# EasyEDA Pro project FPGA-G1.eprj, schematic Schematic1, sheets 7 to 10 of 10

## Sheets
7 GD32F303CBT6
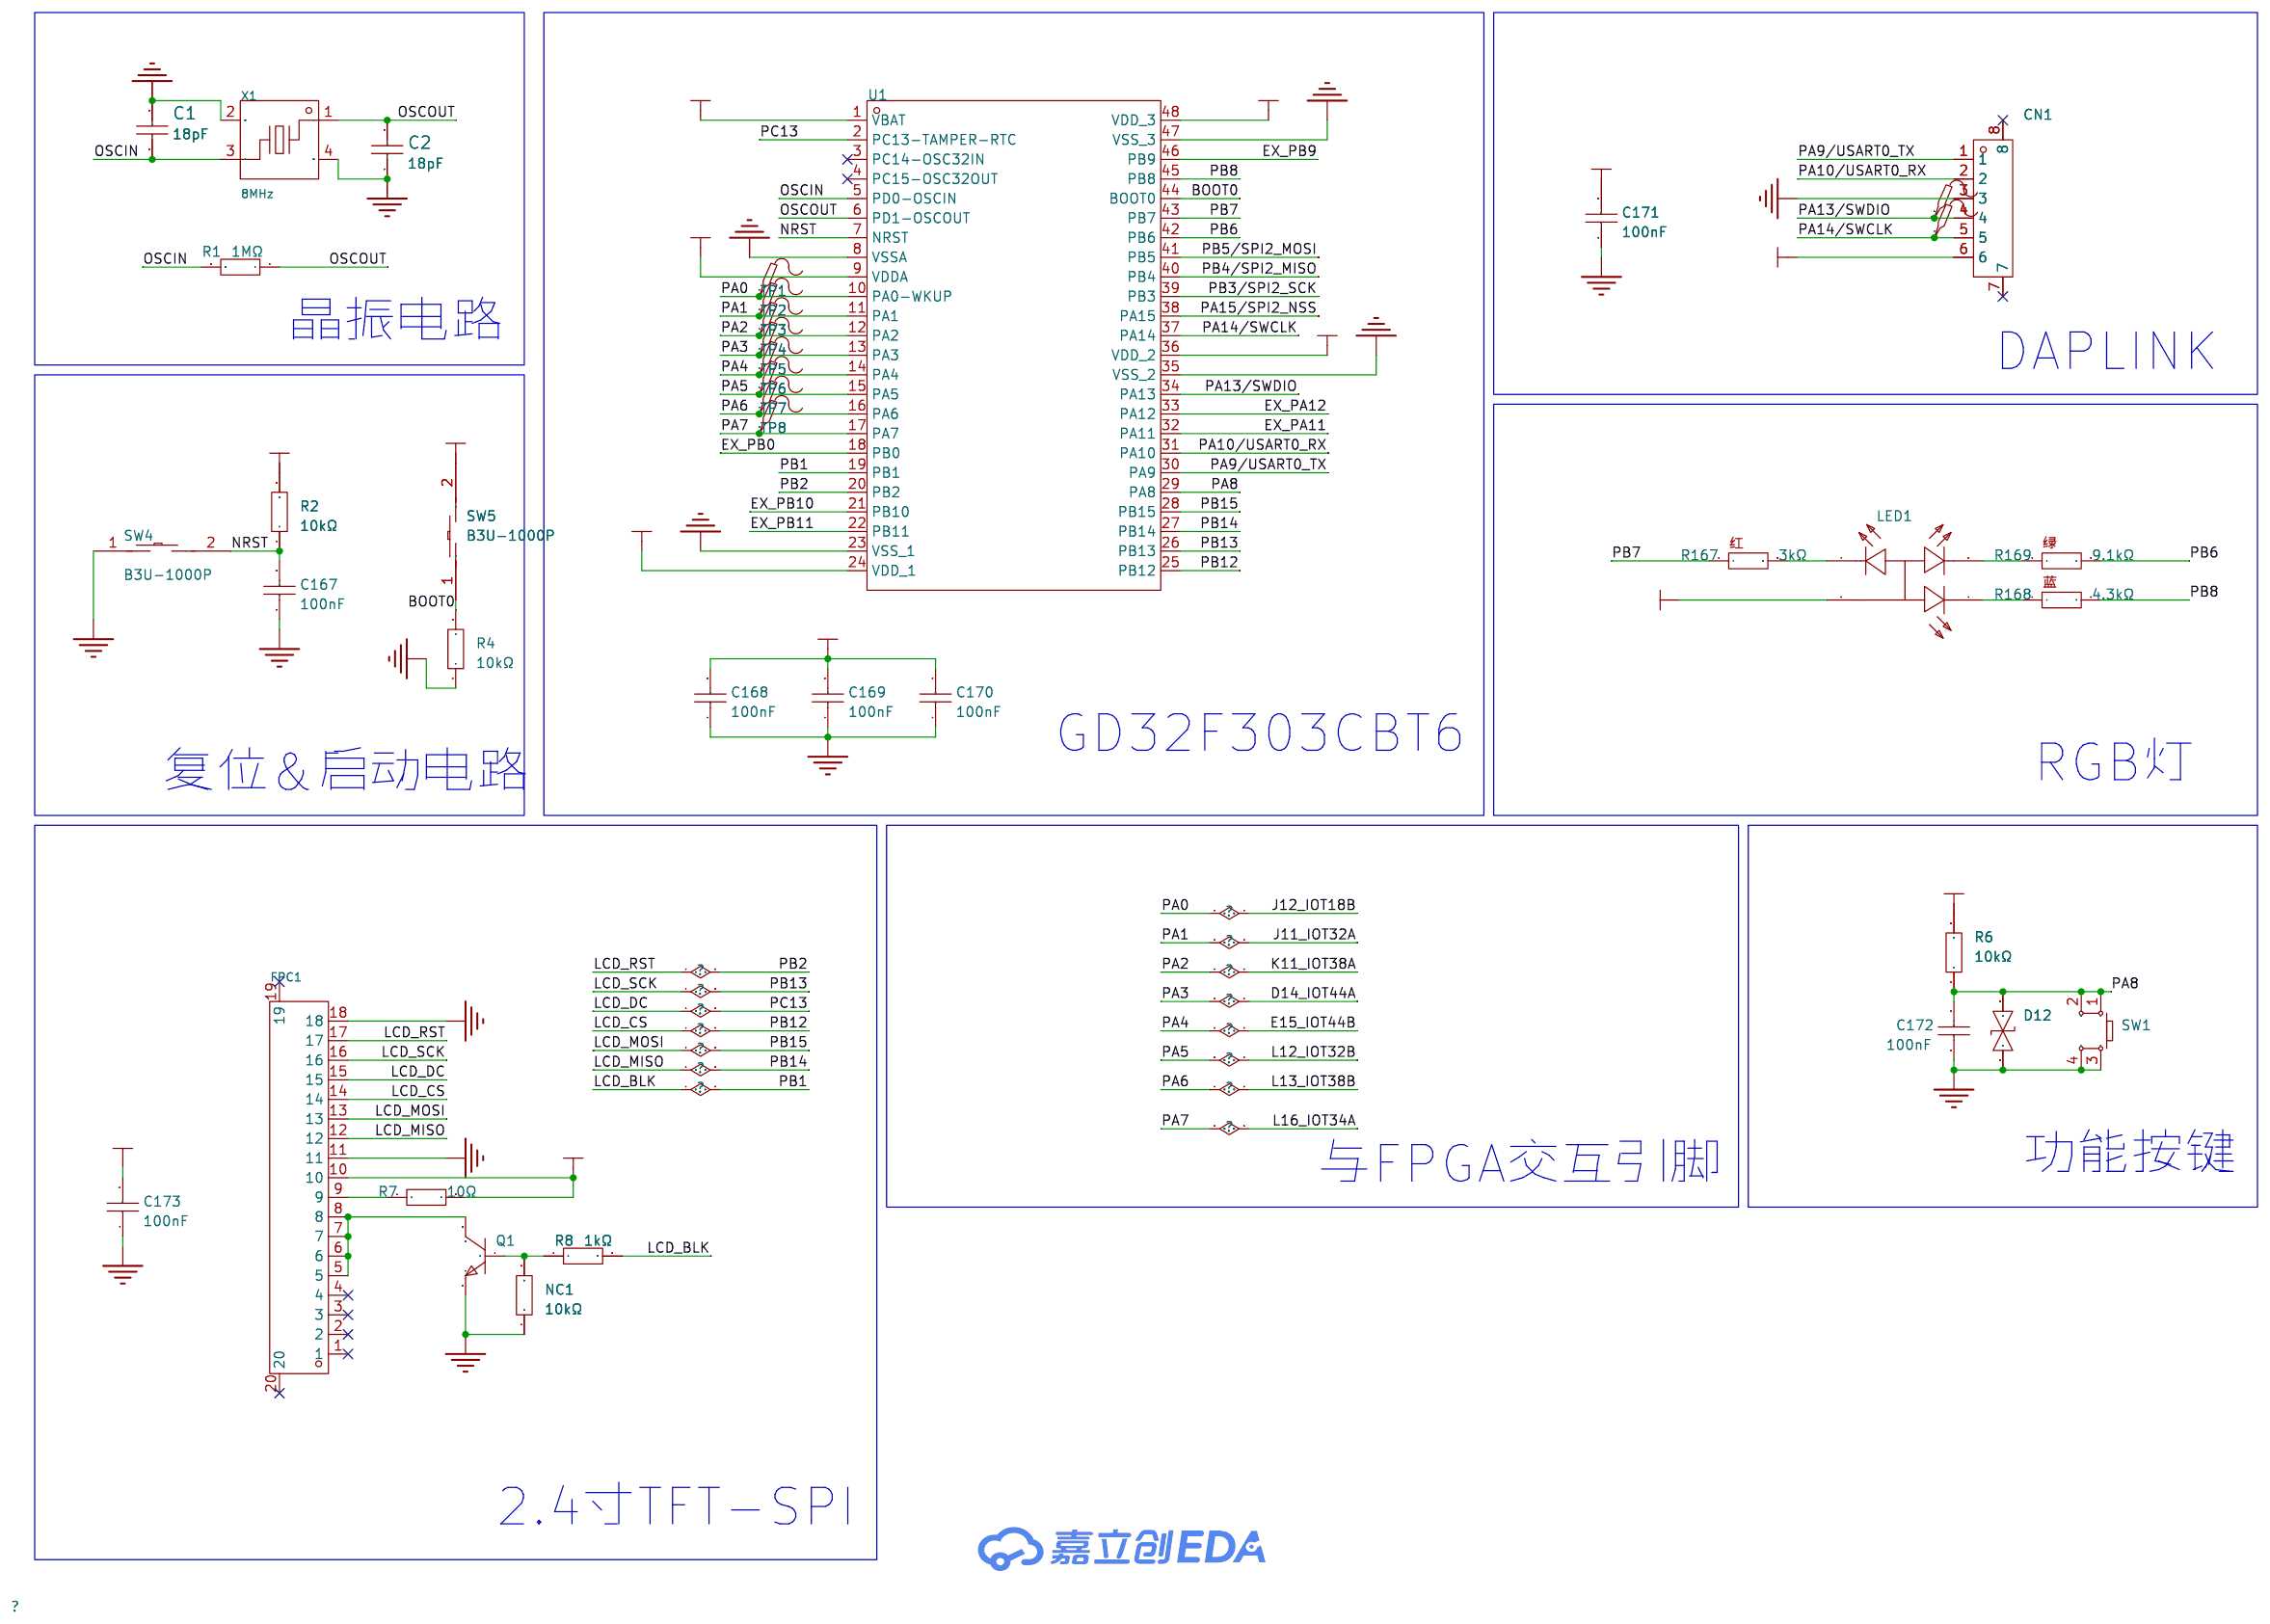
[diagram p6: GD32F303CBT6]
8 Expand
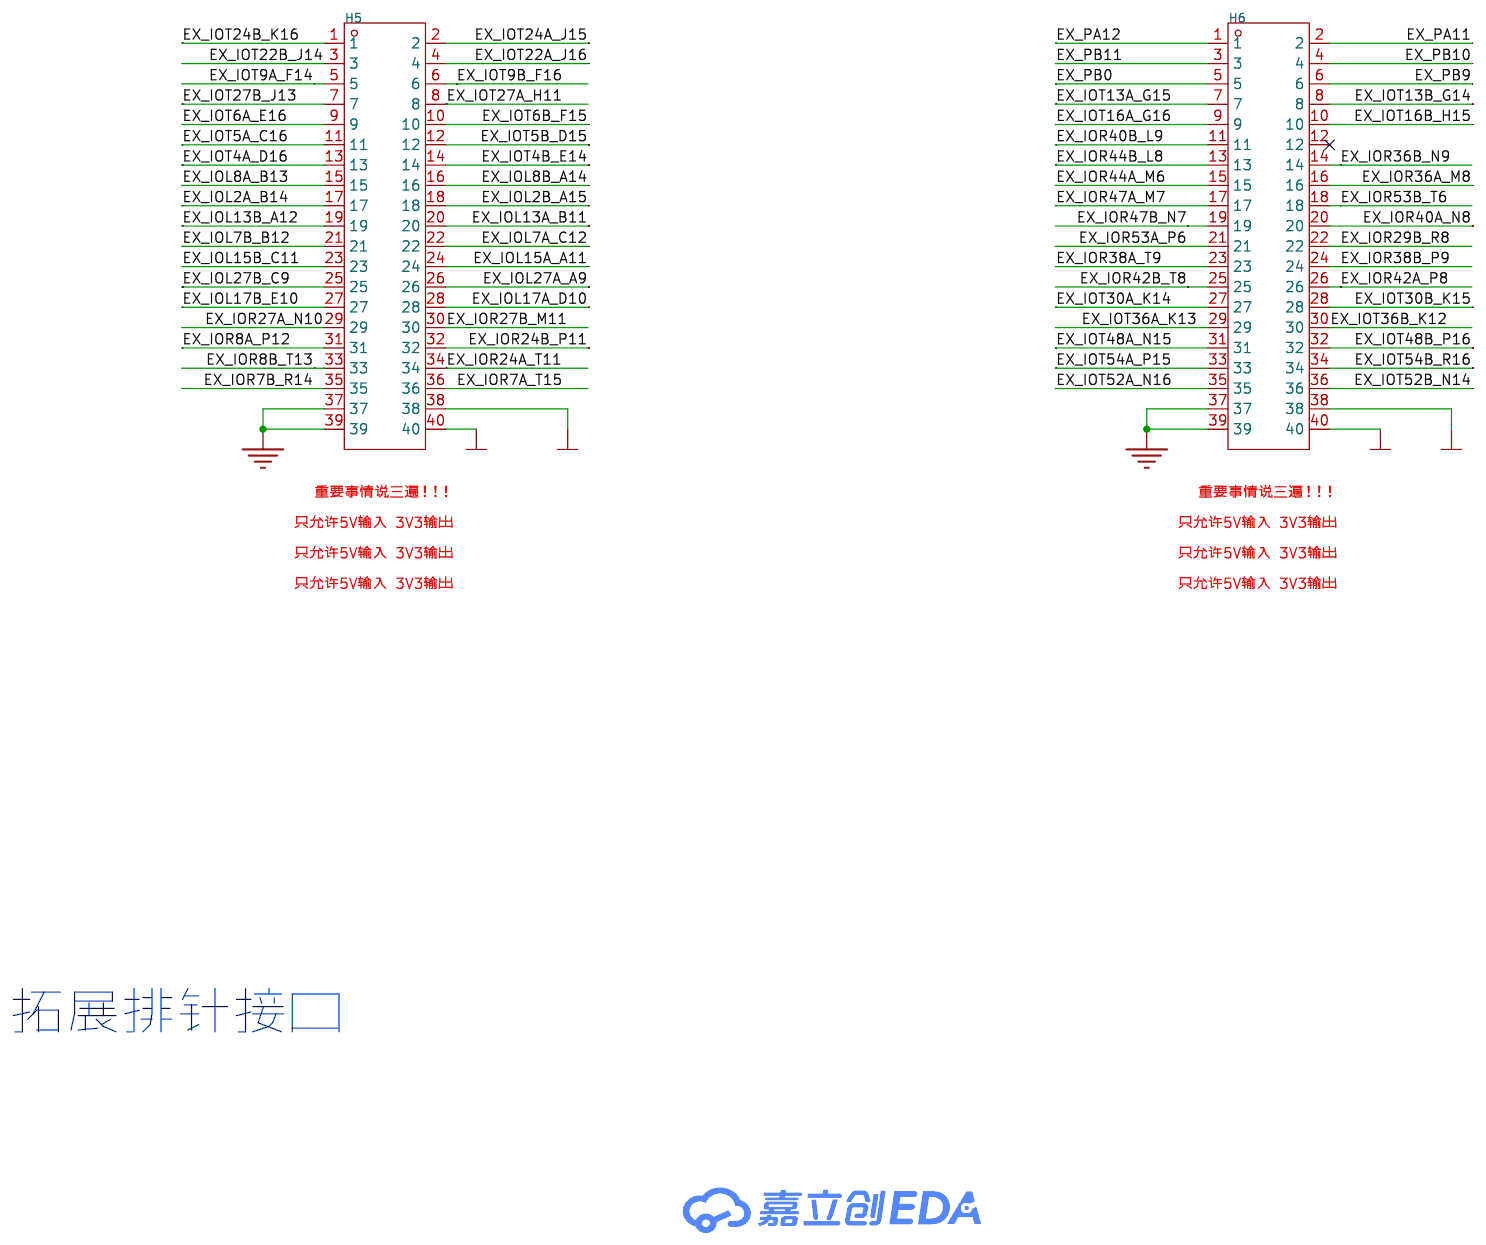
[diagram p7: Expand]
9 GD32_MicroSD
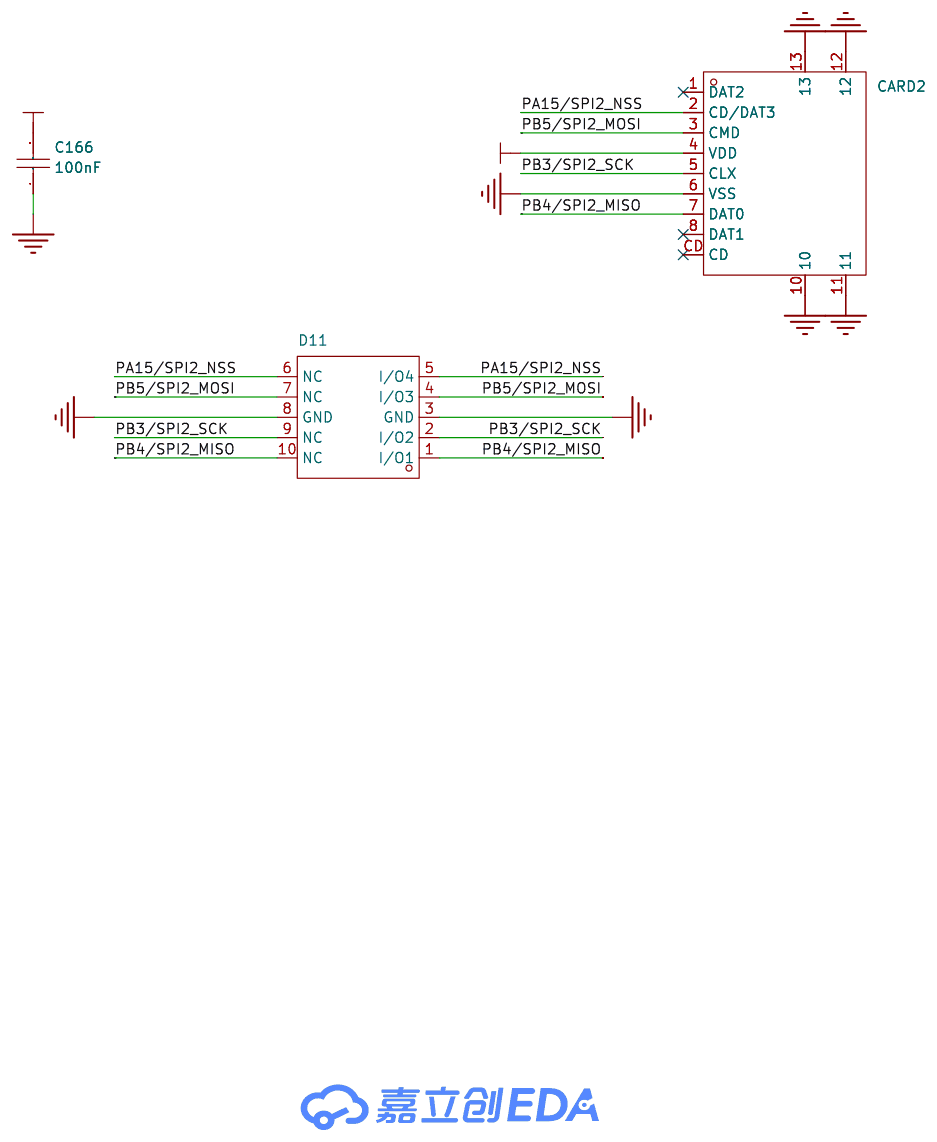
[diagram p8: GD32_MicroSD]
10 Power: Page Name: Power
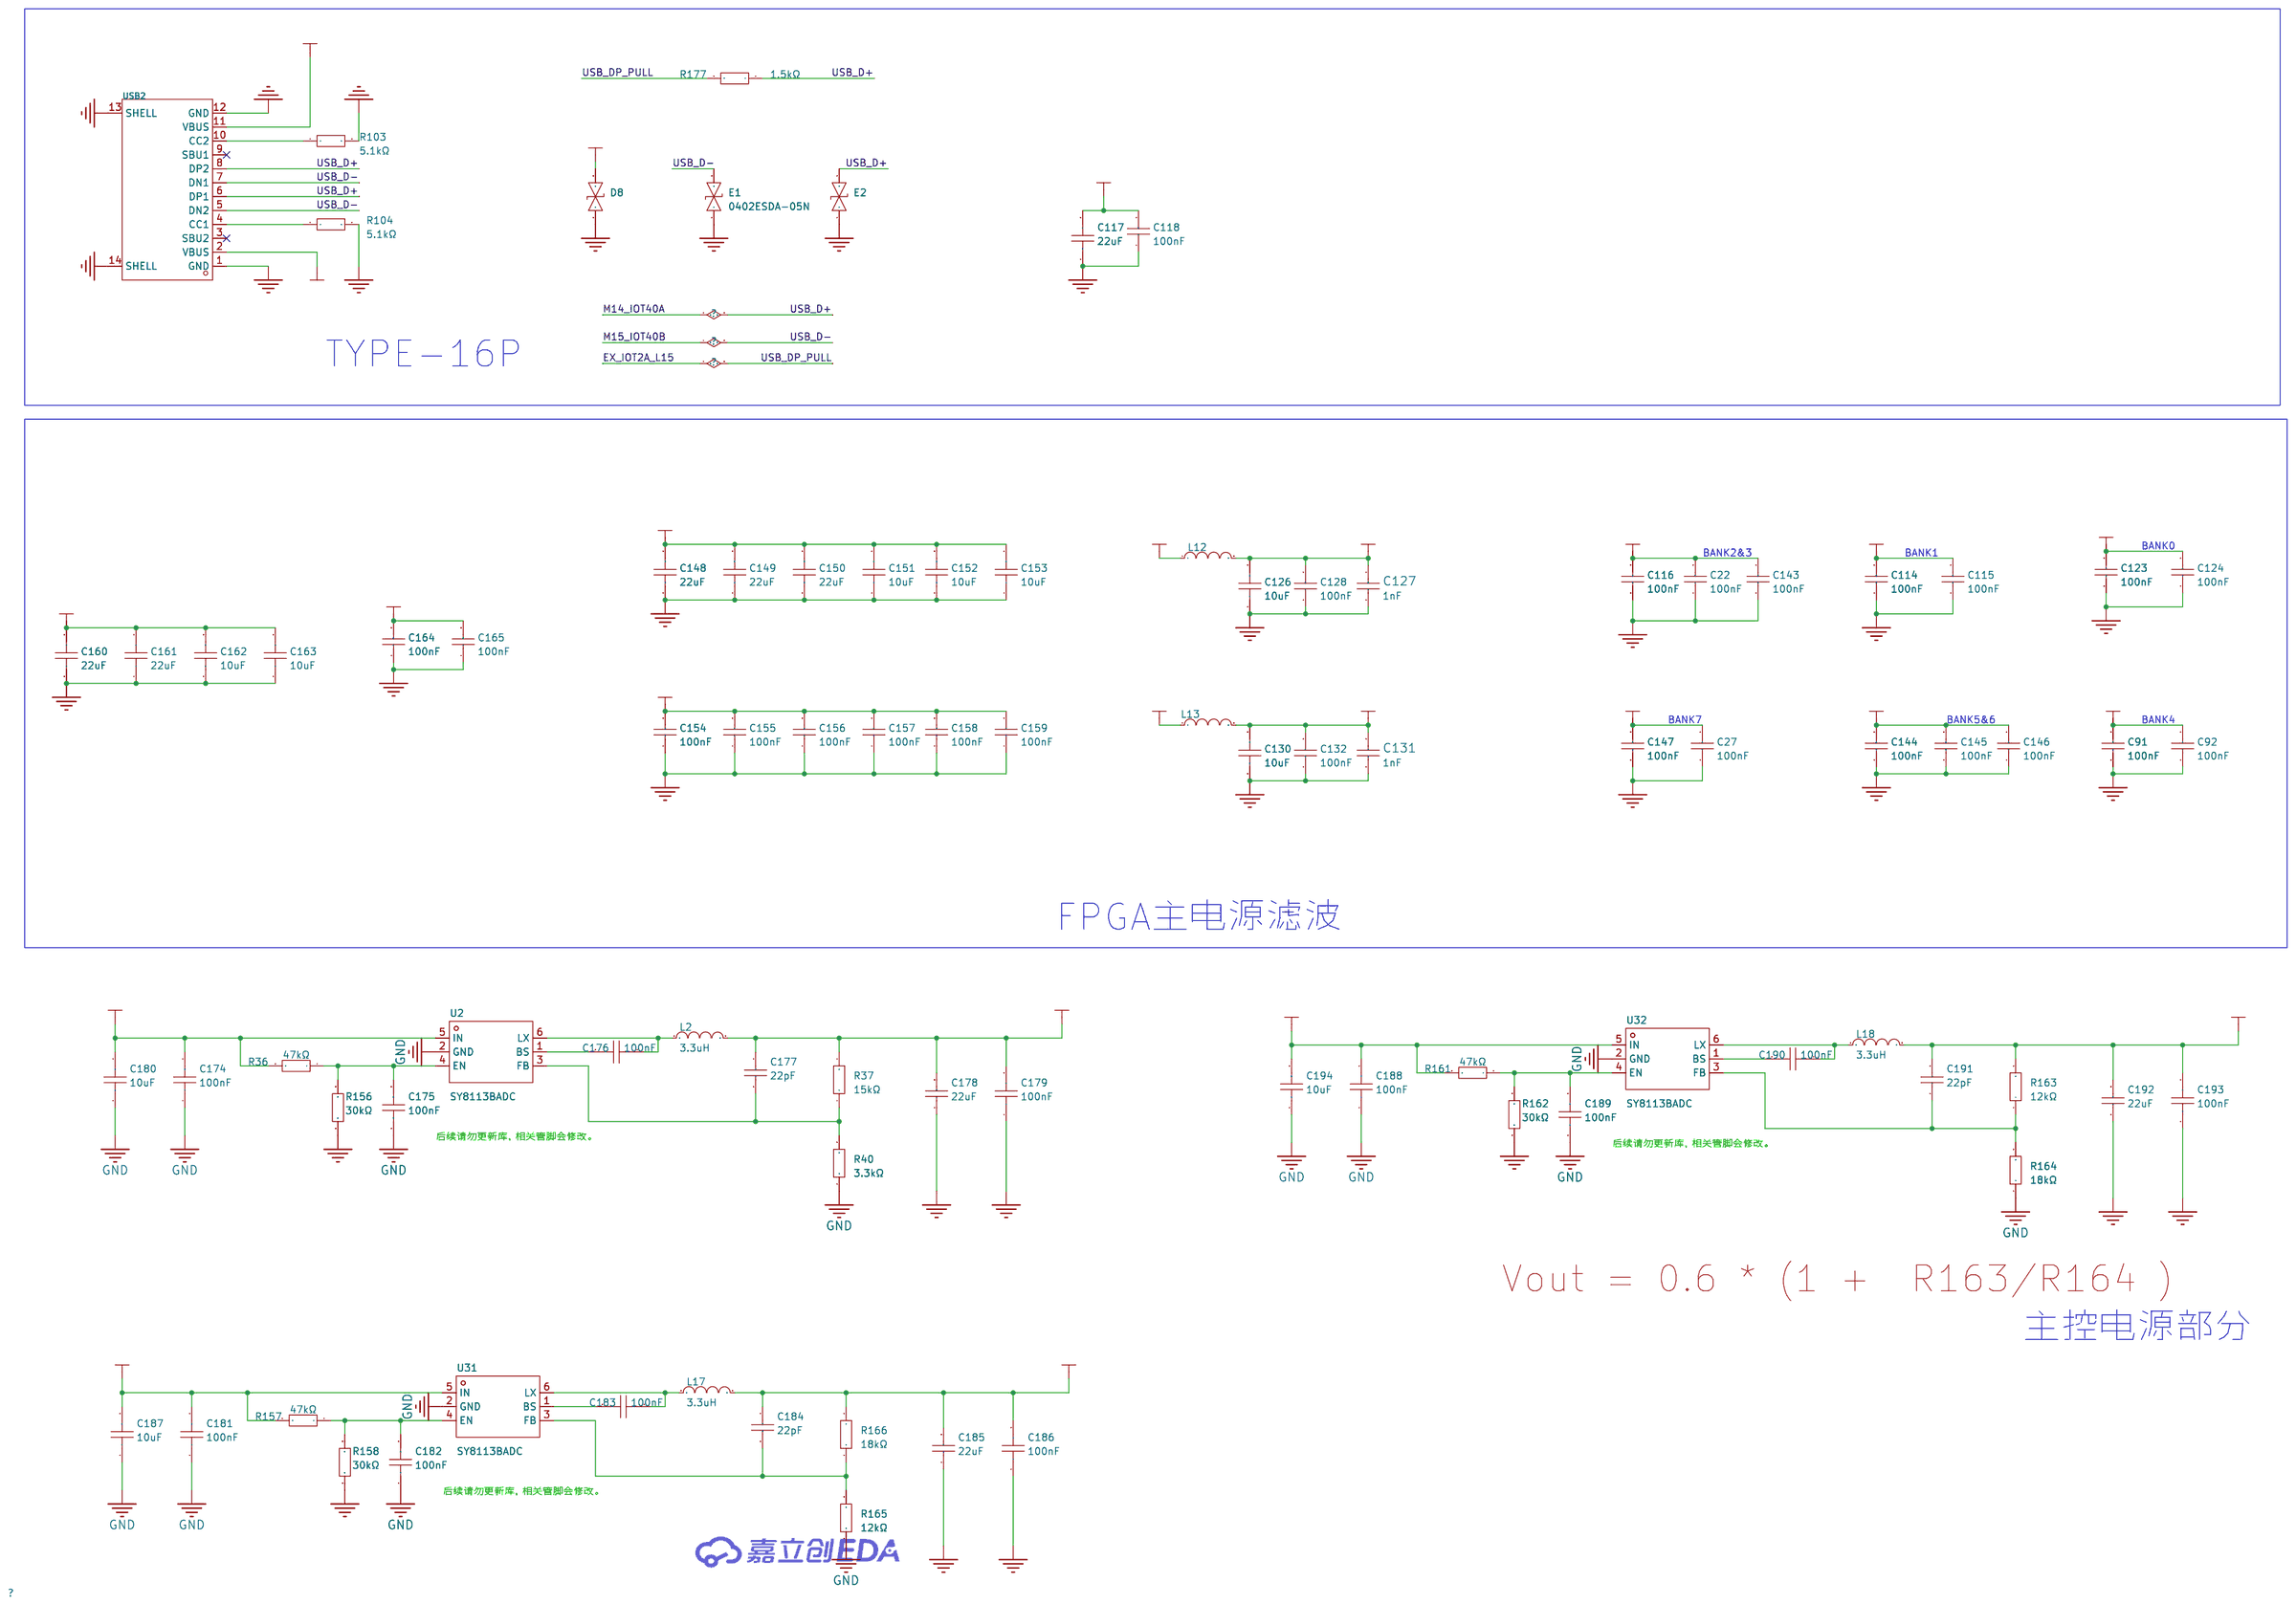
[diagram p9: Power]

## Parts
sheet Expand
H5  12251220ANG0S115001  [HDR-TH_40P-P2.54-V-M-R2-C20-S2.54]
H6  12251220ANG0S115001  [HDR-TH_40P-P2.54-V-M-R2-C20-S2.54]
sheet GD32_MicroSD
C166  100nF  [C0402]
CARD2  TF PUSH  [TF-SMD_TF-PUSH]
D11  RCLAMP0524P  [DFN2510-10_L2.5-W1.0-P0.50-BL]
sheet GD32F303CBT6
C1  18pF  [C0402]
C2  18pF  [C0402]
C167  100nF  [C0402]
C168  100nF  [C0402]
C169  100nF  [C0402]
C170  100nF  [C0402]
C171  100nF  [C0402]
C172  100nF  [C0402]
C173  100nF  [C0402]
CN1  WAFER-100W-6A  [CONN-SMD_6P-P1.00_XUNPU_WAFER-100W-6P]
D12  0402ESDA-05N  [D0402-BI]
FPC1  FPC-05F-18PH20  [FPC-SMD_18P-P0.50_FPC-05F-18PH20]
LED1  E6C0606RGBC3UDA  [LED-SMD_4P-L1.6-W1.6-TL-FD]
NC1  10kΩ  [R0402]
Q1  S8050 J3Y  [SOT-23-3_L3.0-W1.7-P0.95-LS2.9-BR]
R1  1MΩ  [R0402]
R2  10kΩ  [R0402]
R4  10kΩ  [R0402]
R6  10kΩ  [R0402]
R7  10Ω  [R0402]
R8  1kΩ  [R0402]
R167  3kΩ  [R0402]
R168  4.3kΩ  [R0402]
R169  9.1kΩ  [R0402]
SW1  PTS815SJK250SMTRLFS  [SW-SMD_4P-L4.2-W3.3-P2.15-LS5.1]
SW4  B3U-1000P  [KEY-SMD_B3U-1000PM]
SW5  B3U-1000P  [KEY-SMD_B3U-1000PM]
TP1  -  [Test-Point-0.5mm]
TP2  -  [Test-Point-0.5mm]
TP3  -  [Test-Point-0.5mm]
TP4  -  [Test-Point-0.5mm]
TP5  -  [Test-Point-0.5mm]
TP6  -  [Test-Point-0.5mm]
TP7  -  [Test-Point-0.5mm]
TP8  -  [Test-Point-0.5mm]
TP9  -  [Test-Point-0.5mm]
TP10  -  [Test-Point-0.5mm]
U1  GD32F303CBT6  [LQFP-48_L7.0-W7.0-P0.50-LS9.0-BL]
X1  8MHz  [OSC-SMD_4P-L3.2-W2.5-BL]
sheet Power
C22  100nF  [C0402]
C27  100nF  [C0402]
C91  100nF  [C0402]
C92  100nF  [C0402]
C114  100nF  [C0402]
C115  100nF  [C0402]
C116  100nF  [C0402]
C117  22uF  [C0603]
C118  100nF  [C0402]
C123  100nF  [C0402]
C124  100nF  [C0402]
C126  10uF  [C0603]
C127  1nF  [C0402]
C128  100nF  [C0402]
C130  10uF  [C0603]
C131  1nF  [C0402]
C132  100nF  [C0402]
C143  100nF  [C0402]
C144  100nF  [C0402]
C145  100nF  [C0402]
C146  100nF  [C0402]
C147  100nF  [C0402]
C148  22uF  [C0603]
C149  22uF  [C0603]
C150  22uF  [C0603]
C151  10uF  [C0603]
C152  10uF  [C0603]
C153  10uF  [C0603]
C154  100nF  [C0402]
C155  100nF  [C0402]
C156  100nF  [C0402]
C157  100nF  [C0402]
C158  100nF  [C0402]
C159  100nF  [C0402]
C160  22uF  [C0603]
C161  22uF  [C0603]
C162  10uF  [C0603]
C163  10uF  [C0603]
C164  100nF  [C0402]
C165  100nF  [C0402]
C174  100nF  [R0603]
C175  100nF  [R0402]
C176  100nF  [R0402]
C177  22pF  [R0402]
C178  22uF  [C0603]
C179  100nF  [R0603]
C180  10uF  [C0603]
C181  100nF  [R0603]
C182  100nF  [R0402]
C183  100nF  [R0402]
C184  22pF  [R0402]
C185  22uF  [C0603]
C186  100nF  [R0603]
C187  10uF  [C0603]
C188  100nF  [R0603]
C189  100nF  [R0402]
C190  100nF  [R0402]
C191  22pF  [R0402]
C192  22uF  [C0603]
C193  100nF  [R0603]
C194  10uF  [C0603]
D8  0402ESDA-05N  [D0402-BI]
E1  0402ESDA-05N  [D0402-BI]
E2  0402ESDA-05N  [D0402-BI]
L2  3.3uH  [IND-SMD_L4.4-W4.2]
L12  UPZ1005D121-1R3TF  [L0402]
L13  UPZ1005D121-1R3TF  [L0402]
L17  3.3uH  [IND-SMD_L4.4-W4.2]
L18  3.3uH  [IND-SMD_L4.4-W4.2]
R36  47kΩ  [R0402]
R37  15kΩ  [R0402]
R40  3.3kΩ  [R0402]
R103  5.1kΩ  [R0402]
R104  5.1kΩ  [R0402]
R156  30kΩ  [R0402]
R157  47kΩ  [R0402]
R158  30kΩ  [R0402]
R161  47kΩ  [R0402]
R162  30kΩ  [R0402]
R163  12kΩ  [R0402]
R164  18kΩ  [R0402]
R165  12kΩ  [R0402]
R166  18kΩ  [R0402]
R177  1.5kΩ  [R0402]
U2  SY8113BADC  [TSOT-23-6_L2.9-W1.6-P0.95-LS2.8-BR]
U31  SY8113BADC  [TSOT-23-6_L2.9-W1.6-P0.95-LS2.8-BR]
U32  SY8113BADC  [TSOT-23-6_L2.9-W1.6-P0.95-LS2.8-BR]
USB2  TYPE-C 16PIN 2MD(073)  [USB-C-SMD_TYPE-C-6PIN-2MD-073]
